# EasyEDA Pro project EKOPARTY_FINAL.eprj, board PCB1
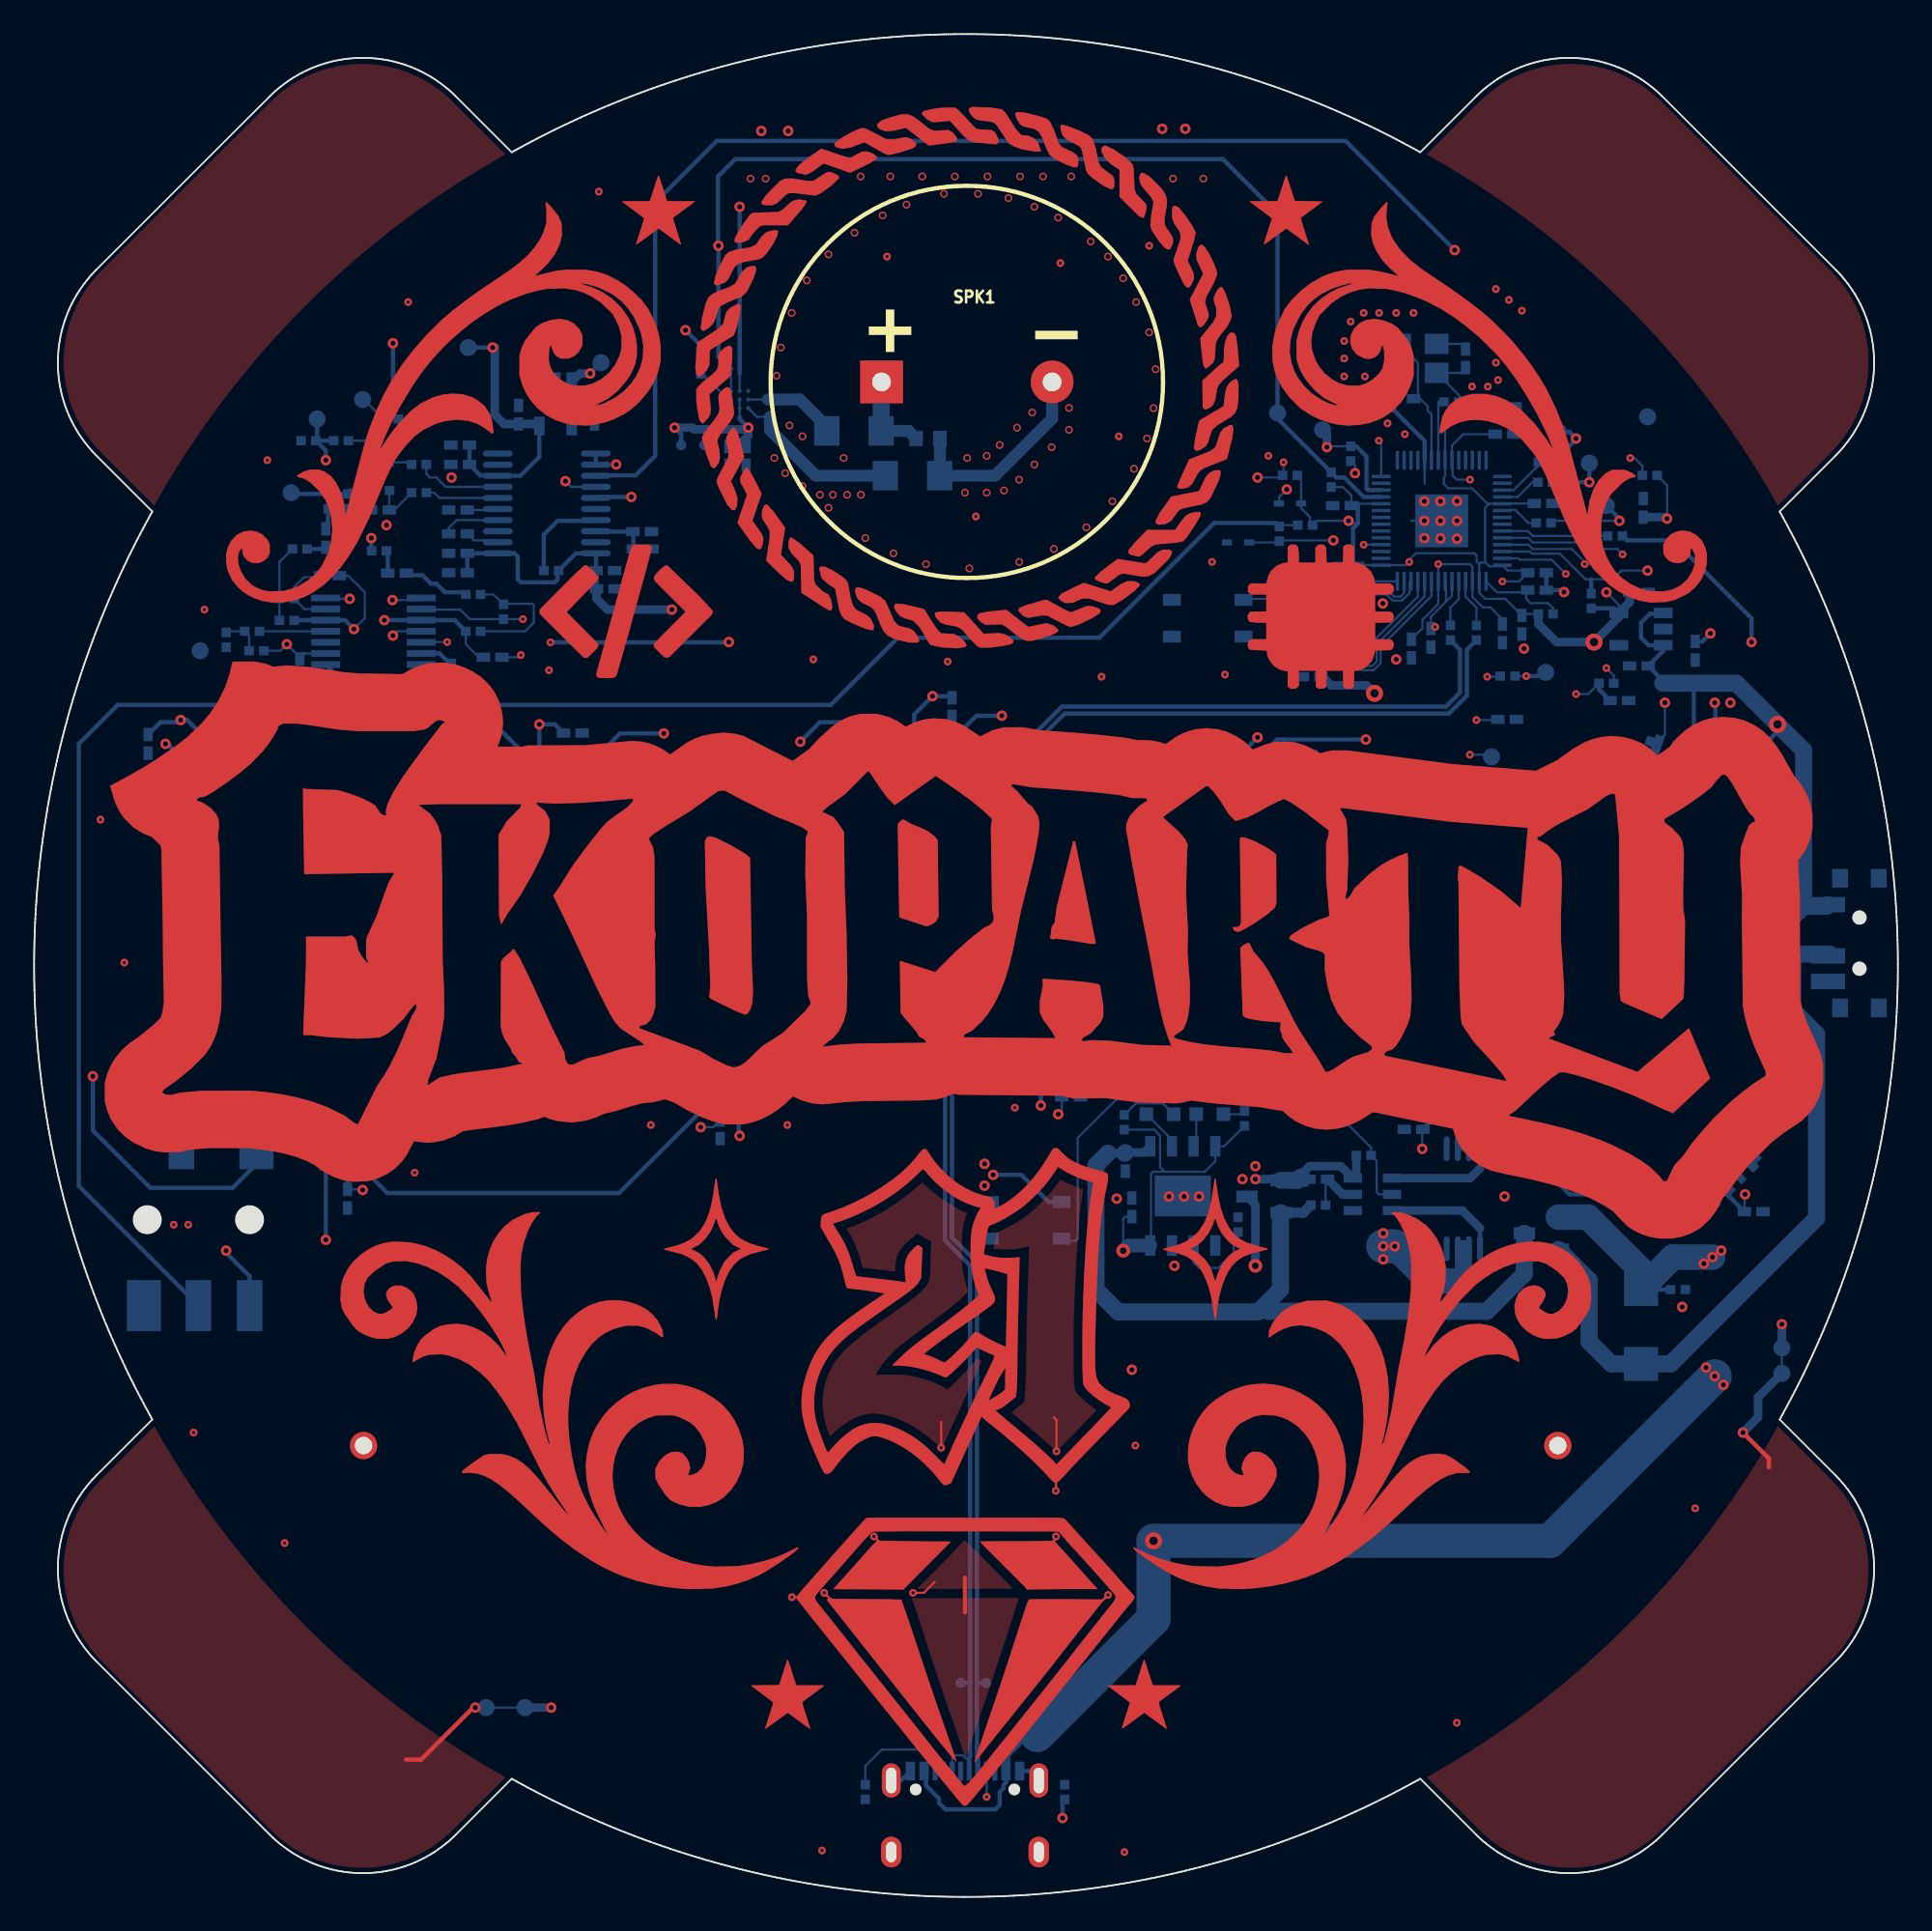
[diagram p1: board, top side]
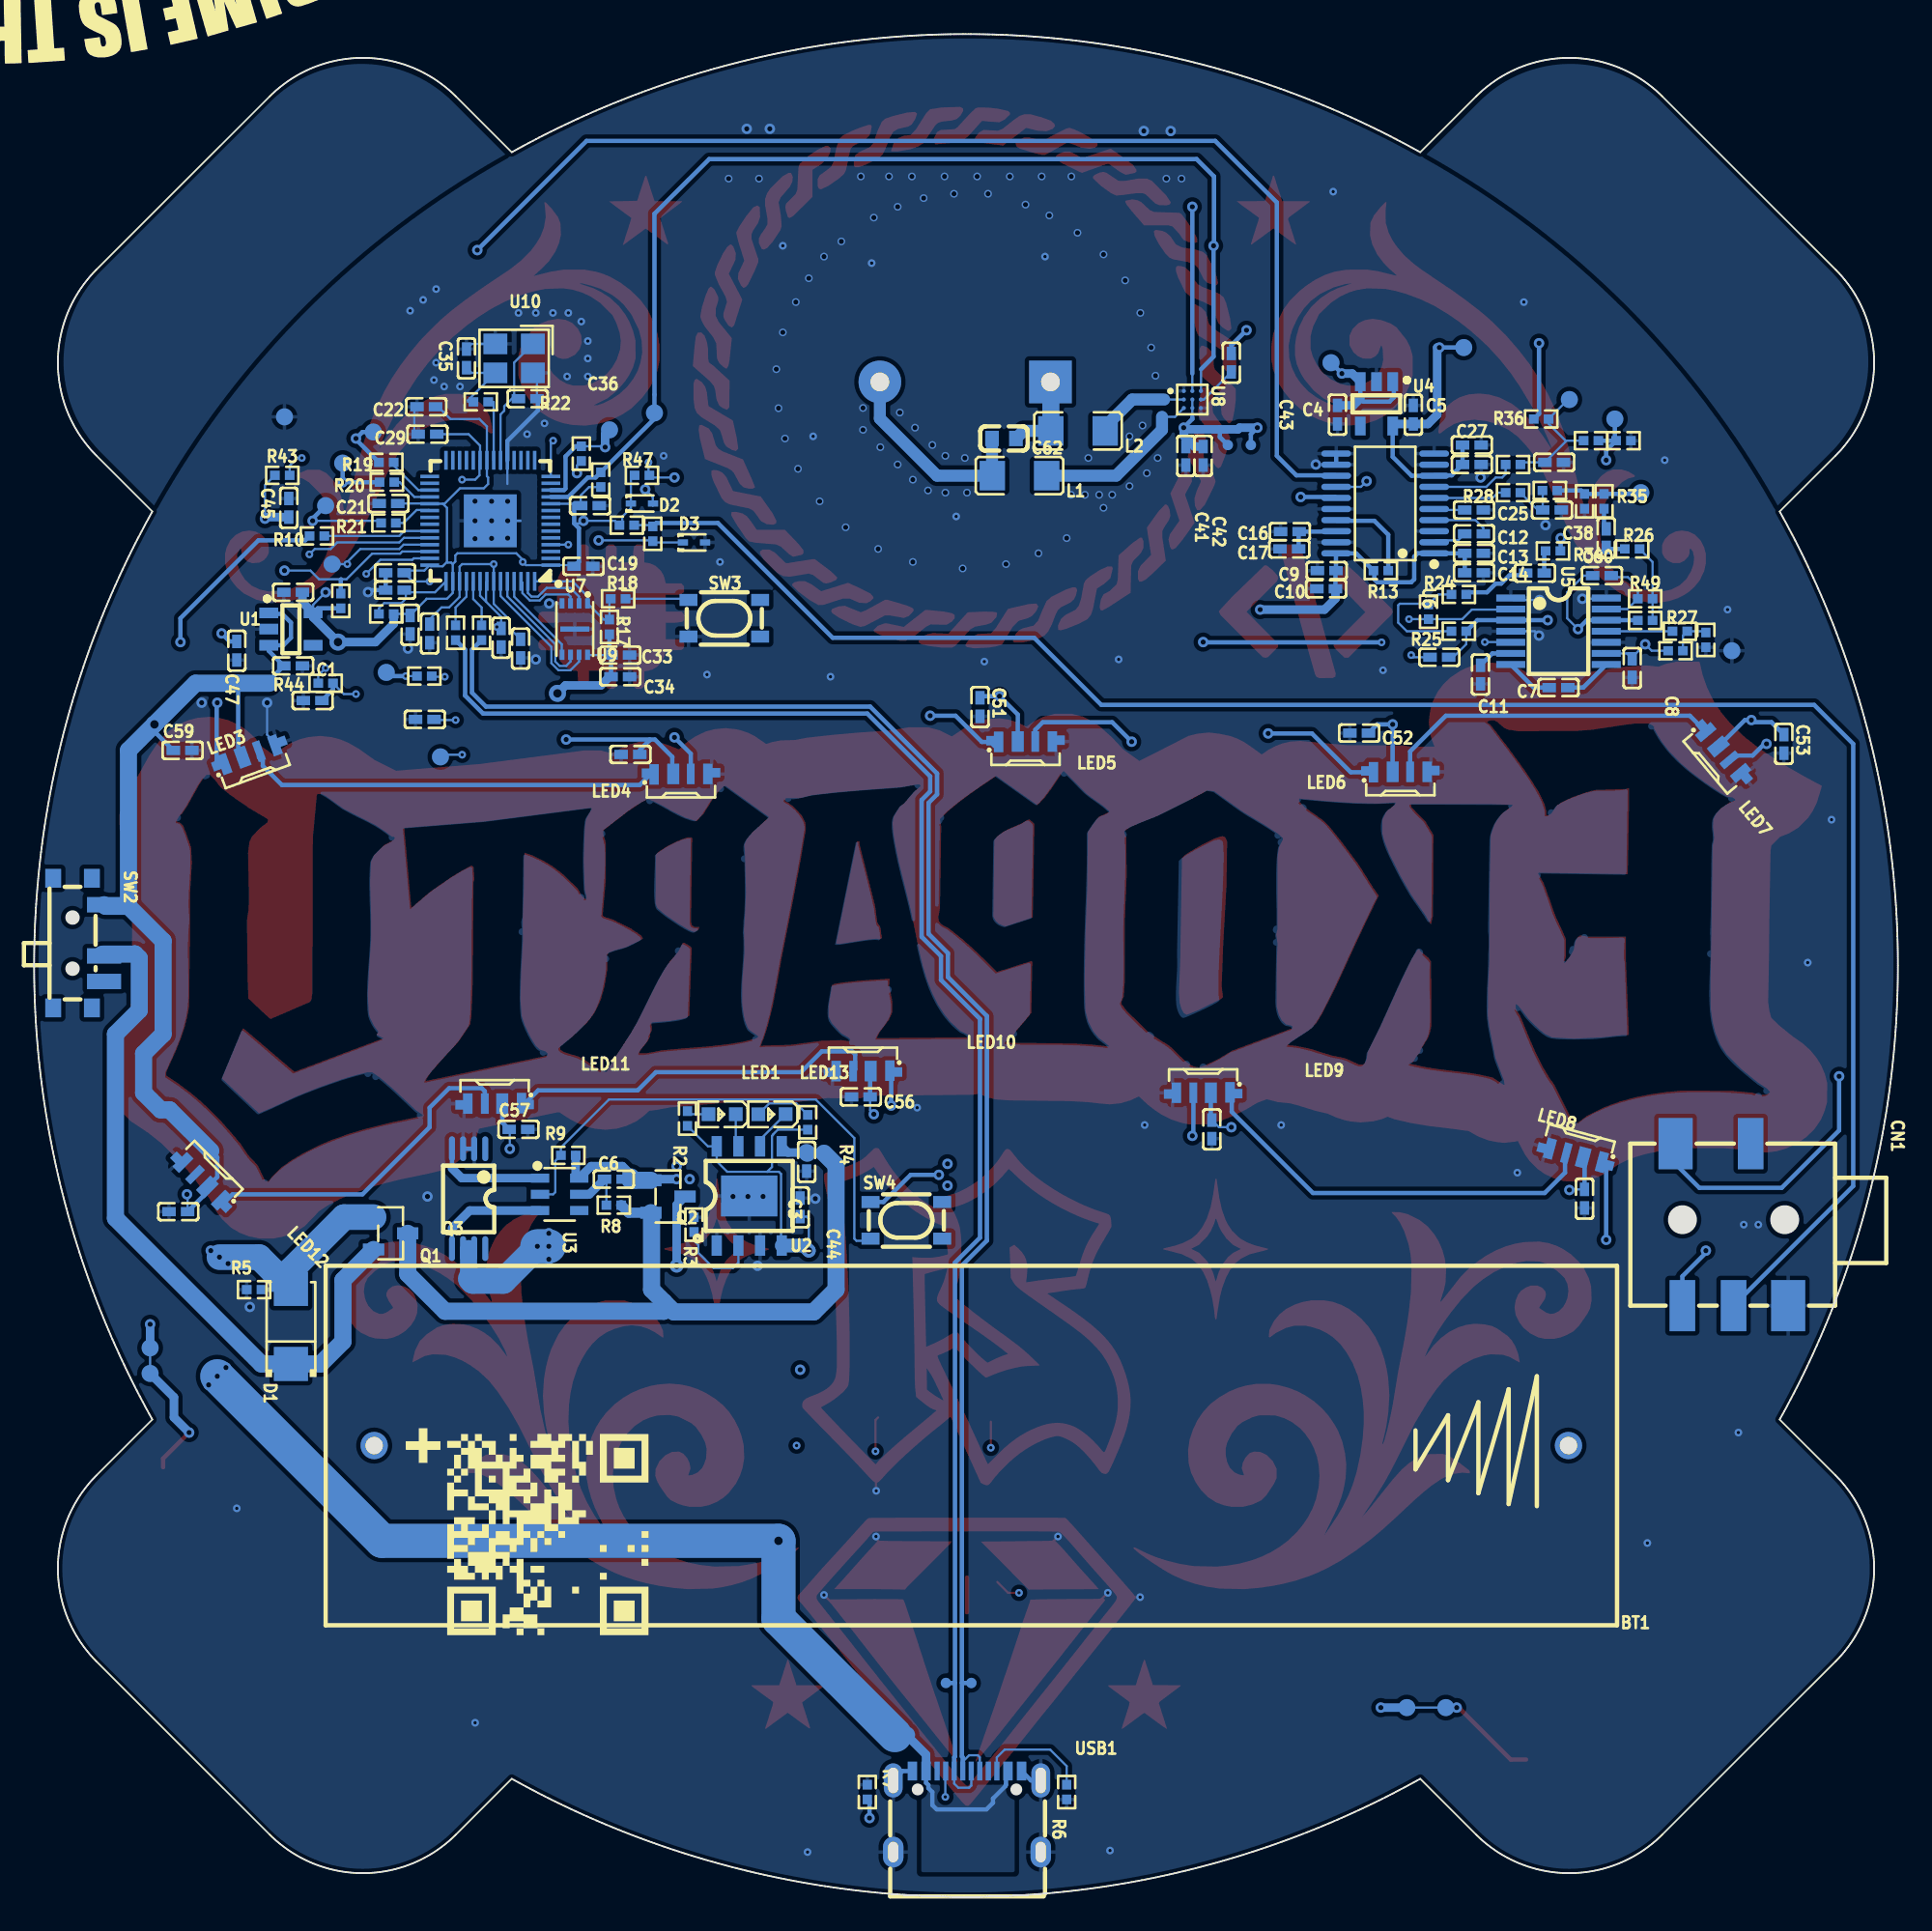
[diagram p2: board, bottom side, seen from below]

Outline 109.24 x 109.24 mm; copper layers: Top Layer, Inner1, Inner2, Bottom Layer. Coordinates in mm from the lower left corner of the outline.
Stack: Top Layer 0.035mm Outer layer thickness 1oz / Dielectric1 0.2104mm 7628 RC49% 8.6mil / Inner1 0.0152mm Inner layer thickness / Dielectric2 1.065mm 1.1mm H/HOZ Copper / Inner2 0.0152mm Inner layer thickness / Dielectric3 0.2104mm 7628 RC49% 8.6mil / Bottom Layer 0.035mm Outer layer thickness 1oz

## Design rules (mm)
net USB_D-: DP1
net USB_D+: DP1
template: Custom Config
spacing copperThickness1oz (default): track to track 0.1, other pairs 0 to 0.3
spacing copperThickness2oz: track to track 0.203, other pairs 0.152 to 0.3
track width copperThickness1oz (default): min 0.089, default 0.127, max 2.54
track width copperThickness2oz: min 0.203, default 0.254, max 2.54
differential pair differentialPair (default): width min 0.127, default 0.127, max 2.54; gap min 0.152, default 0.152
via viaSize (default): diameter min 0.25, default 0.45, max 10; hole min 0.15, default 0.2, max 6.299

## Placement (name value [footprint] x y rotation side)
BT1  BH-18650  [BAT-TH_BH-18650-A1AJ005]  54.31 26.47 0 bottom
C1  2.2uF  [C0402]  94.06 72.19 180 bottom
C2  10uF  [C0402]  94.06 76.51 0 bottom
C3  10uF  [C0402]  63.96 43.11 90 bottom
C4  2.2uF  [C0402]  32.84 86.92 270 bottom
C5  10uF  [C0402]  28.4 86.92 90 bottom
C6  100nF  [C0402]  75.26 42.09 180 bottom
C7  1uF  [C0402]  19.89 70.92 180 bottom
C8  1uF  [C0402]  15.57 72.06 90 bottom
C9  10uF  [C0402]  33.48 77.78 180 bottom
C10  100nF  [C0402]  33.51 76.71 0 bottom
C11  1uF  [C0402]  24.46 71.68 90 bottom
C12  2.2uF  [C0402]  24.84 79.94 180 bottom
C13  100nF  [C0402]  24.84 78.79 180 bottom
C14  10uF  [C0402]  24.84 77.65 0 bottom
C15  2.2uF  [C0402]  87.2 74.6 270 bottom
C16  10uF  [C0402]  35.64 80.06 0 bottom
C17  100nF  [C0402]  35.67 79.05 180 bottom
C18  2.2uF  [C0402]  86.06 74.09 270 bottom
C19  100nF  [C0402]  77.04 78.03 180 bottom
C20  100nF  [C0402]  76.66 81.59 180 bottom
C21  100nF  [C0402]  88.47 81.71 0 bottom
C22  100nF  [C0402]  86.25 87.39 0 bottom
C23  100nF  [C0402]  81.87 73.84 270 bottom
C24  100nF  [C0402]  88.09 77.65 0 bottom
C25  2.2uF  [C0402]  24.84 81.33 180 bottom
C26  100nF  [C0402]  80.72 73.2 90 bottom
C27  100nF  [C0402]  24.97 85.14 180 bottom
C28  10uF  [C0402]  24.97 84 0 bottom
C29  100nF  [C0402]  86.18 85.78 180 bottom
C30  2.2uF  [C0402]  88.09 76.63 180 bottom
C33  2.2uF  [C0402]  74.88 72.82 180 bottom
C34  100nF  [C0402]  74.88 71.55 180 bottom
C35  15pF  [C0402]  83.9 90.22 270 bottom
C36  15pF  [C0402]  80.31 87.86 0 bottom
C37  2.2uF  [C0402]  21.27 77.63 180 bottom
C38  2.2uF  [C0402]  17.1 79.68 270 bottom
C39  100nF  [C0402]  20.27 81.33 180 bottom
C40  100nF  [C0402]  20.14 84.13 180 bottom
C41  10uF  [C0402]  41.73 84.51 90 bottom
C42  100nF  [C0402]  40.72 84.51 270 bottom
C43  2.2uF  [C0402]  39.07 89.97 90 bottom
C44  10uF  [C0402]  64.34 40.44 90 bottom
C45  47nF  [C0402]  94.31 81.46 270 bottom
C46  47nF  [C0402]  92.92 70.16 180 bottom
C47  47nF  [C0402]  97.36 73.08 90 bottom
C48  47nF  [C0402]  86.34 69.05 180 bottom
C50  100nF  [C0402]  74.29 67 0 bottom
C51  100nF  [C0402]  53.8 69.78 270 bottom
C52  100nF  [C0402]  31.57 68.25 0 bottom
C53  100nF  [C0402]  6.68 67.62 270 bottom
C54  100nF  [C0402]  18.37 40.95 270 bottom
C55  100nF  [C0402]  40.21 45.01 270 bottom
C56  100nF  [C0402]  60.78 46.92 0 bottom
C57  100nF  [C0402]  80.85 45.01 180 bottom
C58  100nF  [C0402]  100.79 40.18 0 bottom
C59  10uF  [C0402]  100.54 67.24 180 bottom
C60  47pF  [C0402]  17.35 77.48 180 bottom
C61  47pF  [C0402]  26.88 72.7 0 bottom
C62  1uF  [C0603]  52.39 85.53 0 bottom
CN1  PJ-365  [AUDIO-SMD_HOOYA_PJ-365]  9.73 39.42 270 bottom
D1  SS34  [SMA_L4.3-W2.6-LS5.2-RD]  94.19 33.45 90 bottom
D2  1N4148WT-7  [SOD-523_L1.2-W0.8-LS1.6-RD]  73.61 81.71 180 bottom
D3  1N4148WT-7  [SOD-523_L1.2-W0.8-LS1.6-RD]  70.56 79.43 180 bottom
L1  10uH  [L1206]  51.48 83.35 0 bottom
L2  10uH  [L1206]  48.05 85.97 0 bottom
LED1  KT-0603R  [LED0603-RD]  68.91 45.9 0 bottom
LED3  SK6812SIDE-A-RVS  [LED-SMD_4P-L4.0-W1.6-L]  96.6 66.98 160 bottom
LED4  SK6812SIDE-A-RVS  [LED-SMD_4P-L4.0-W1.6-L]  71.33 65.84 180 bottom
LED5  SK6812SIDE-A-RVS  [LED-SMD_4P-L4.0-W1.6-L]  51.13 67.74 180 bottom
LED6  SK6812SIDE-A-RVS  [LED-SMD_4P-L4.0-W1.6-L]  29.16 65.97 180 bottom
LED7  SK6812SIDE-A-RVS  [LED-SMD_4P-L4.0-W1.6-L]  10.24 67.11 230 bottom
LED8  SK6812SIDE-A-RVS  [LED-SMD_4P-L4.0-W1.6-L]  18.87 43.49 15 bottom
LED9  SK6812SIDE-A-RVS  [LED-SMD_4P-L4.0-W1.6-L]  40.72 47.17 0 bottom
LED10  SK6812SIDE-A-RVS  [LED-SMD_4P-L4.0-W1.6-L]  60.66 48.44 0 bottom
LED11  SK6812SIDE-A-RVS  [LED-SMD_4P-L4.0-W1.6-L]  82.25 46.53 0 bottom
LED12  SK6812SIDE-A-RVS  [LED-SMD_4P-L4.0-W1.6-L]  99.39 41.96 45 bottom
LED13  XL-1608UBC-04  [LED0603-RD_BLUE]  65.99 45.9 0 bottom
NOREF  -  [Pad_e780]  88.6 71.81 0 top
NOREF#2  -  [Pad_e799]  89.36 85.9 0 top
NOREF#3  -  [Pad_e818]  28.78 11.1 0 top
NOREF#4  -  [Pad_e797]  9.73 73.08 0 top
NOREF#5  -  [Pad_e815]  15.06 82.35 0 top
NOREF#6  -  [Pad_e932]  72.88 87.02 0 top
NOREF#7  -  [Pad_e787]  25.45 90.86 0 top
NOREF#8  -  [Pad_e145]  19.26 87.81 0 top
NOREF#9  -  [Pad_e793]  33.23 89.97 0 top
NOREF#10  -  [Pad_e1269]  54.31 12.55 0 top
NOREF#11  -  [Pad_e22]  37.92 85.14 0 top
NOREF#12  -  [Pad_e5615]  91.77 78.16 0 top
NOREF#13  -  [Pad_e1270]  55.8 12.55 0 top
NOREF#14  -  [Pad_e5608]  85.42 66.85 0 top
NOREF#15  -  [Pad_e811]  16.59 86.67 0 top
NOREF#16  -  [Pad_e24]  39.28 85.14 0 top
NOREF#17  -  [Pad_e803]  91.15 84.08 0 top
NOREF#18  -  [Pad_e911]  75.52 86.03 0 top
NOREF#19  -  [Pad_e806]  92.15 81.59 0 top
NOREF#20  -  [Pad_e810]  94.57 86.79 0 top
NOREF#21  -  [Pad_e889]  102.44 32.2 0 top
NOREF#22  -  [Pad_e874]  102.44 30.7 0 top
NOREF#23  -  [Pad_e909]  26.49 11.1 0 top
Q1  FDN340P  [SOT-23-3_L2.9-W1.3-P1.90-LS2.4-BR]  88.34 38.91 0 bottom
Q2  FDN340P  [SOT-23-3_L2.9-W1.3-P1.90-LS2.4-BR]  72.09 41.07 0 bottom
Q3  8205A  [TSSOP-8_L4.4-W3.0-P0.65-LS6.4-BL]  83.77 40.95 0 bottom
R2  1kΩ  [R0402]  70.94 45.65 90 bottom
R3  2kΩ  [R0402]  70.56 39.42 270 bottom
R4  1kΩ  [R0402]  63.9 45.43 90 bottom
R5  10kΩ  [R0402]  96.34 35.61 180 bottom
R6  5.1kΩ  [R0402]  48.72 6.15 90 bottom
R7  5.1kΩ  [R0402]  60.4 6.15 270 bottom
R8  100Ω  [R0402]  75.26 40.57 180 bottom
R9  1kΩ  [R0402]  77.93 43.49 180 bottom
R10  100Ω  [R0402]  92.66 79.81 180 bottom
R11  1kΩ  [R0402]  13.03 73.08 180 bottom
R12  1kΩ  [R0402]  11.25 73.71 270 bottom
R13  10kΩ  [R0402]  30.3 77.78 0 bottom
R14  27Ω  [R0402]  88.6 75.24 180 bottom
R15  27Ω  [R0402]  83.01 74.13 270 bottom
R16  27Ω  [R0402]  84.54 74.13 270 bottom
R17  10kΩ  [R0402]  75.52 74.47 270 bottom
R18  1kΩ  [R0402]  75.01 76.13 0 bottom
R19  27Ω  [R0402]  88.6 84.13 0 bottom
R20  27Ω  [R0402]  88.56 82.96 0 bottom
R21  27Ω  [R0402]  88.47 80.57 0 bottom
R22  1kΩ  [R0402]  83.06 87.67 0 bottom
R23  100kΩ  [R0402]  74.5 80.44 0 bottom
R24  10kΩ  [R0402]  25.73 76.38 180 bottom
R25  10kΩ  [R0402]  25.73 74.22 0 bottom
R26  10kΩ  [R0402]  15.57 79.05 180 bottom
R27  10kΩ  [R0402]  14.81 74.86 0 bottom
R28  100Ω  [R0402]  22.56 82.35 0 bottom
R29  100Ω  [R0402]  22.56 84 0 bottom
R30  10kΩ  [R0402]  20.4 82.48 0 bottom
R31  10kΩ  [R0402]  18.37 81.84 270 bottom
R32  10kΩ  [R0402]  17.99 85.4 0 bottom
R33  10kΩ  [R0402]  16.08 85.4 180 bottom
R34  1kΩ  [R0402]  20.22 78.93 0 bottom
R35  1kΩ  [R0402]  17.22 81.84 90 bottom
R36  1kΩ  [R0402]  20.91 86.67 0 bottom
R39  10kΩ  [R0402]  76.02 83.11 270 bottom
R40  10kΩ  [R0402]  77.17 84.63 90 bottom
R41  5.1kΩ  [R0402]  12.78 74.22 0 bottom
R42  1kΩ  [R0402]  72.98 79.94 90 bottom
R43  1MΩ  [R0402]  94.69 83.36 180 bottom
R44  1MΩ  [R0402]  92.15 71.17 0 bottom
R45  1MΩ  [R0402]  91.26 76 270 bottom
R46  1MΩ  [R0402]  86.37 71.59 0 bottom
R47  10kΩ  [R0402]  73.61 83.36 0 bottom
R48  10kΩ  [R0402]  27.51 75.36 90 bottom
R49  10kΩ  [R0402]  14.81 76.13 0 bottom
SPK1  GSPK2307P-8R1W  [SPK-TH_BD23.0-P10.00-D0.8-L-RD]  54.67 88.84 0 top
SW2  MK-12C02-G015  [SW-SMD_G-SWITCH_MK-12C02-G015]  106.63 55.93 270 bottom
SW3  SKRPACE010  [KEY-SMD_4P-L4.2-W3.2-P2.20-LS4.6]  68.79 74.98 180 bottom
SW4  SKRPACE010  [KEY-SMD_4P-L4.2-W3.2-P2.20-LS4.6]  58.12 39.68 180 bottom
U1  AP2112K-3.3TRG1  [SOT-25-5_L2.9-W1.6-P0.95-LS2.8-BL]  94.19 74.35 270 bottom
U2  TP4056  [ESOP-8_L4.9-W3.9-P1.27-LS6.0-BL-EP]  67.33 41.11 180 bottom
U3  DW01  [SOT-23-6_L2.9-W1.6-P0.95-LS2.8-BL]  78.44 41.2 270 bottom
U4  AP2112K-3.3TRG1  [SOT-25-5_L2.9-W1.6-P0.95-LS2.8-BL]  30.56 87.56 0 bottom
U5  TPA6138A2  [TSSOP-14_L5.0-W4.4-P0.65-LS6.4-BL]  19.89 74.22 270 bottom
U6  PCM5100APWR  [TSSOP-20_L6.5-W4.4-P0.65-LS6.4-BL]  30.05 81.71 90 bottom
U7  RP2040  [LQFN-56_L7.0-W7.0-P0.4-EP]  82.5 80.7 0 bottom
U8  TPA2028D1YZFR  [DSBGA-9_L1.6-W1.6-R3-C3-P0.50-BL]  41.35 87.81 270 bottom
U9  W25Q16JVUXIQ  [USON-8_L3.0-W2.0-P0.50-BL-EP]  77.55 74.35 0 bottom
U10  12Mhz  [CRYSTAL-SMD_4P-L3.2-W2.5-BL]  81.1 90.22 0 bottom
USB1  TYPE-C 16PIN 2MD  [USB-C-SMD_TYPE-C-6PIN-2MD-073]  54.56 5.01 180 bottom

## Footprints (pads in the part's own frame, mm; a bottom-side part is the same pattern mirrored in y, then rotated)
AUDIO-SMD_HOOYA_PJ-365
  rect 3x1.5 smd: 3(4.75,-2.9) 4(4.75,0.1) 6(-4.75,1.1)
  rect 3x2 smd: 5(4.75,3.3) 7(-4.75,-3.3)
BAT-TH_BH-18650-A1AJ005
  round 1.6 hole 1.02: 1(-35,0) 2(35,0)
C0402
  rect 0.79x0.54 smd: 1(-0.545,0) 2(0.545,0)
C0603
  rect 0.8x0.9 smd: 1(-0.7,0) 2(0.7,0)
CRYSTAL-SMD_4P-L3.2-W2.5-BL
  rect 1.4x1.2 smd: 1(-1.1,-0.85) 2(1.1,-0.85) 3(1.1,0.85) 4(-1.1,0.85)
DSBGA-9_L1.6-W1.6-R3-C3-P0.50-BL
  round 0.24 smd: A1(-0.5,-0.5) A2(-0.5,0) A3(-0.5,0.5) B1(0,-0.5) B2(0,0) B3(0,0.5) C1(0.5,-0.5) C2(0.5,0) C3(0.5,0.5)
ESOP-8_L4.9-W3.9-P1.27-LS6.0-BL-EP
  rect 0.6x1.2 smd: 1(-1.905,-2.909) 2(-0.635,-2.909) 3(0.635,-2.909) 4(1.905,-2.909) 5(1.905,2.909) 6(0.635,2.909) 7(-0.635,2.909) 8(-1.905,2.909)
  rect 3.3x2.4 smd: 9(0,0)
KEY-SMD_4P-L4.2-W3.2-P2.20-LS4.6
  rect 1.05x0.7 smd: 1(-2.1,1.075) 2(2.1,1.075) 3(-2.1,-1.075) 4(2.1,-1.075)
L1206
  rect 1.485x1.728 smd: 1(-1.593,0) 2(1.593,0)
LED0603-RD
  rect 0.8x0.8 smd: 1(-0.799,0) 2(0.799,0)
LED0603-RD_BLUE
  rect 0.8x0.8 smd: 1(-0.799,-0.004) 2(0.799,0.004)
LED-SMD_4P-L4.0-W1.6-L
  custom 1x1.2 smd: 1(-1.8,-0.013) 4(1.8,0.013)
  custom 0.7x1.2 smd: 2(-0.45,0.013)
  custom 0.45x1.2 smd: 3(0.575,0.013)
LQFN-56_L7.0-W7.0-P0.4-EP
  rect 1.1x0.2 smd: 1(-3.55,2.6) 2(-3.55,2.2) 3(-3.55,1.8) 4(-3.55,1.4) 5(-3.55,1) 6(-3.55,0.6) 7(-3.55,0.2) 8(-3.55,-0.2) 9(-3.55,-0.6) 10(-3.55,-1) 11(-3.55,-1.4) 12(-3.55,-1.8) 13(-3.55,-2.2) 14(-3.55,-2.6) 29(3.55,-2.6) 30(3.55,-2.2) 31(3.55,-1.8) 32(3.55,-1.4) 33(3.55,-1) 34(3.55,-0.6) 35(3.55,-0.2) 36(3.55,0.2) 37(3.55,0.6) 38(3.55,1) 39(3.55,1.4) 40(3.55,1.8) 41(3.55,2.2) 42(3.55,2.6)
  rect 0.2x1.1 smd: 15(-2.6,-3.55) 16(-2.2,-3.55) 17(-1.8,-3.55) 18(-1.4,-3.55) 19(-1,-3.55) 20(-0.6,-3.55) 21(-0.2,-3.55) 22(0.2,-3.55) 23(0.6,-3.55) 24(1,-3.55) 25(1.4,-3.55) 26(1.8,-3.55) 27(2.2,-3.55) 28(2.6,-3.55) 43(2.6,3.55) 44(2.2,3.55) 45(1.8,3.55) 46(1.4,3.55) 47(1,3.55) 48(0.6,3.55) 49(0.2,3.55) 50(-0.2,3.55) 51(-0.6,3.55) 52(-1,3.55) 53(-1.4,3.55) 54(-1.8,3.55) 55(-2.2,3.55) 56(-2.6,3.55)
  rect 3.1x3.1 smd: 57(0,0)
Pad_e22
  round 0.61 smd far side: TP1(0,0)
Pad_e24
  round 0.61 smd far side: TP2(0,0)
Pad_e145
  round 1 smd far side: TP3(0,0)
Pad_e780
  round 1 smd far side: TP1(0,0)
Pad_e787
  round 1 smd far side: TP2(0,0)
Pad_e793
  oval 1x1 smd far side: TP3(0,0)
Pad_e797
  oval 1x1 smd far side: TP4(0,0)
Pad_e799
  oval 1x1 smd far side: TP5(0,0)
Pad_e803
  oval 1x1 smd far side: TP6(0,0)
Pad_e806
  oval 1x1 smd far side: TP7(0,0)
Pad_e810
  oval 1x1 smd far side: TP7(0,0)
Pad_e811
  oval 1x1 smd far side: TP8(0,0)
Pad_e815
  oval 1x1 smd far side: TP8(0,0)
Pad_e818
  oval 1x1 smd far side: TP9(0,0)
Pad_e874
  oval 1x1 smd far side: TP11(0,0)
Pad_e889
  oval 1x1 smd far side: TP8(0,0)
Pad_e909
  oval 1x1 smd far side: TP9(0,0)
Pad_e911
  oval 1x1 smd far side: TP9(0,0)
Pad_e932
  oval 1x1 smd far side: TP9(0,0)
Pad_e1269
  round 0.61 smd far side: TP1(0,0)
Pad_e1270
  round 0.61 smd far side: TP2(0,0)
Pad_e5608
  oval 1x1 smd far side: TP14(0,0)
Pad_e5615
  oval 1x1 smd far side: TP15(0,0)
R0402
  rect 0.566x0.54 smd: 1(-0.433,0) 2(0.433,0)
SMA_L4.3-W2.6-LS5.2-RD
  rect 2x2 smd: 1(-2.2,0) 2(2.2,0)
SOD-523_L1.2-W0.8-LS1.6-RD
  rect 0.6x0.36 smd: 1(-0.65,0) 2(0.65,0)
SOT-23-3_L2.9-W1.3-P1.90-LS2.4-BR
  rect 1.25x0.7 smd: 1(1,-0.95) 2(1,0.95) 3(-1,0)
SOT-23-6_L2.9-W1.6-P0.95-LS2.8-BL
  rect 0.532x1.072 smd: 1(-0.95,-1.149) 2(0,-1.149) 3(0.95,-1.149) 4(0.95,1.149) 5(0,1.149) 6(-0.95,1.149)
SOT-25-5_L2.9-W1.6-P0.95-LS2.8-BL
  rect 0.623x1.105 smd: 1(-0.95,-1.3) 2(-0.001,-1.3) 3(0.95,-1.3) 4(0.95,1.3) 5(-0.95,1.3)
SPK-TH_BD23.0-P10.00-D0.8-L-RD
  rect 2.5x2.5 hole 1.1: 1(-5,0)
  round 2.5 hole 1.1: 2(5,0)
SW-SMD_G-SWITCH_MK-12C02-G015
  rect 0.9x2 smd: 1(-2.25,1.49) 2(0.75,1.49) 3(2.25,1.49)
  rect 1.1x0.93 smd: 4(3.8,0.779) 5(3.8,-1.49) 6(-3.8,-1.49) 7(-3.8,0.779)
TSSOP-8_L4.4-W3.0-P0.65-LS6.4-BL
  oval 0.353x1.454 smd: 1(-0.975,-2.927) 2(-0.325,-2.927) 3(0.325,-2.927) 4(0.975,-2.927) 5(0.975,2.927) 6(0.325,2.927) 7(-0.325,2.927) 8(-0.975,2.927)
TSSOP-14_L5.0-W4.4-P0.65-LS6.4-BL
  rect 0.4x1.7 smd: 1(-1.95,-2.8) 2(-1.3,-2.8) 3(-0.65,-2.8) 4(0,-2.8) 5(0.65,-2.8) 6(1.3,-2.8) 7(1.95,-2.8) 8(1.95,2.8) 9(1.3,2.8) 10(0.65,2.8) 11(0,2.8) 12(-0.65,2.8) 13(-1.3,2.8) 14(-1.95,2.8)
TSSOP-20_L6.5-W4.4-P0.65-LS6.4-BL
  oval 0.364x1.742 smd: 1(-2.925,-2.871) 2(-2.275,-2.871) 3(-1.625,-2.871) 4(-0.975,-2.871) 5(-0.325,-2.871) 6(0.325,-2.871) 7(0.975,-2.871) 8(1.625,-2.871) 9(2.275,-2.871) 10(2.925,-2.871) 11(2.925,2.871) 12(2.275,2.871) 13(1.625,2.871) 14(0.975,2.871) 15(0.325,2.871) 16(-0.325,2.871) 17(-0.975,2.871) 18(-1.625,2.871) 19(-2.275,2.871) 20(-2.925,2.871)
USB-C-SMD_TYPE-C-6PIN-2MD-073
  rect 0.55x1.1 smd: 1(-3.2,2.375) 2(-2.4,2.375) 11(2.4,2.375) 12(3.2,2.375)
  rect 0.3x1.1 smd: 3(-1.75,2.375) 4(-1.25,2.375) 5(-0.75,2.375) 6(-0.25,2.375) 7(0.25,2.375) 8(0.75,2.375) 9(1.25,2.375) 10(1.75,2.375)
  oval 1.2x1.8 hole 0.6x1.2: 13(-4.325,-2.375) 14(4.325,-2.375)
  oval 1.1x2 hole 0.6x1.5: 13(-4.325,1.825) 14(4.325,1.825)
USON-8_L3.0-W2.0-P0.50-BL-EP
  rect 0.28x0.6 smd: 1(-0.75,-1.508) 2(-0.25,-1.508) 3(0.25,-1.508) 4(0.75,-1.508) 5(0.75,1.508) 6(0.25,1.508) 7(-0.25,1.508) 8(-0.75,1.508)
  rect 1.7x0.3 smd: 9(0,0)
